# EasyEDA Pro project ca_car.eprj, board ca_pcb (continued)
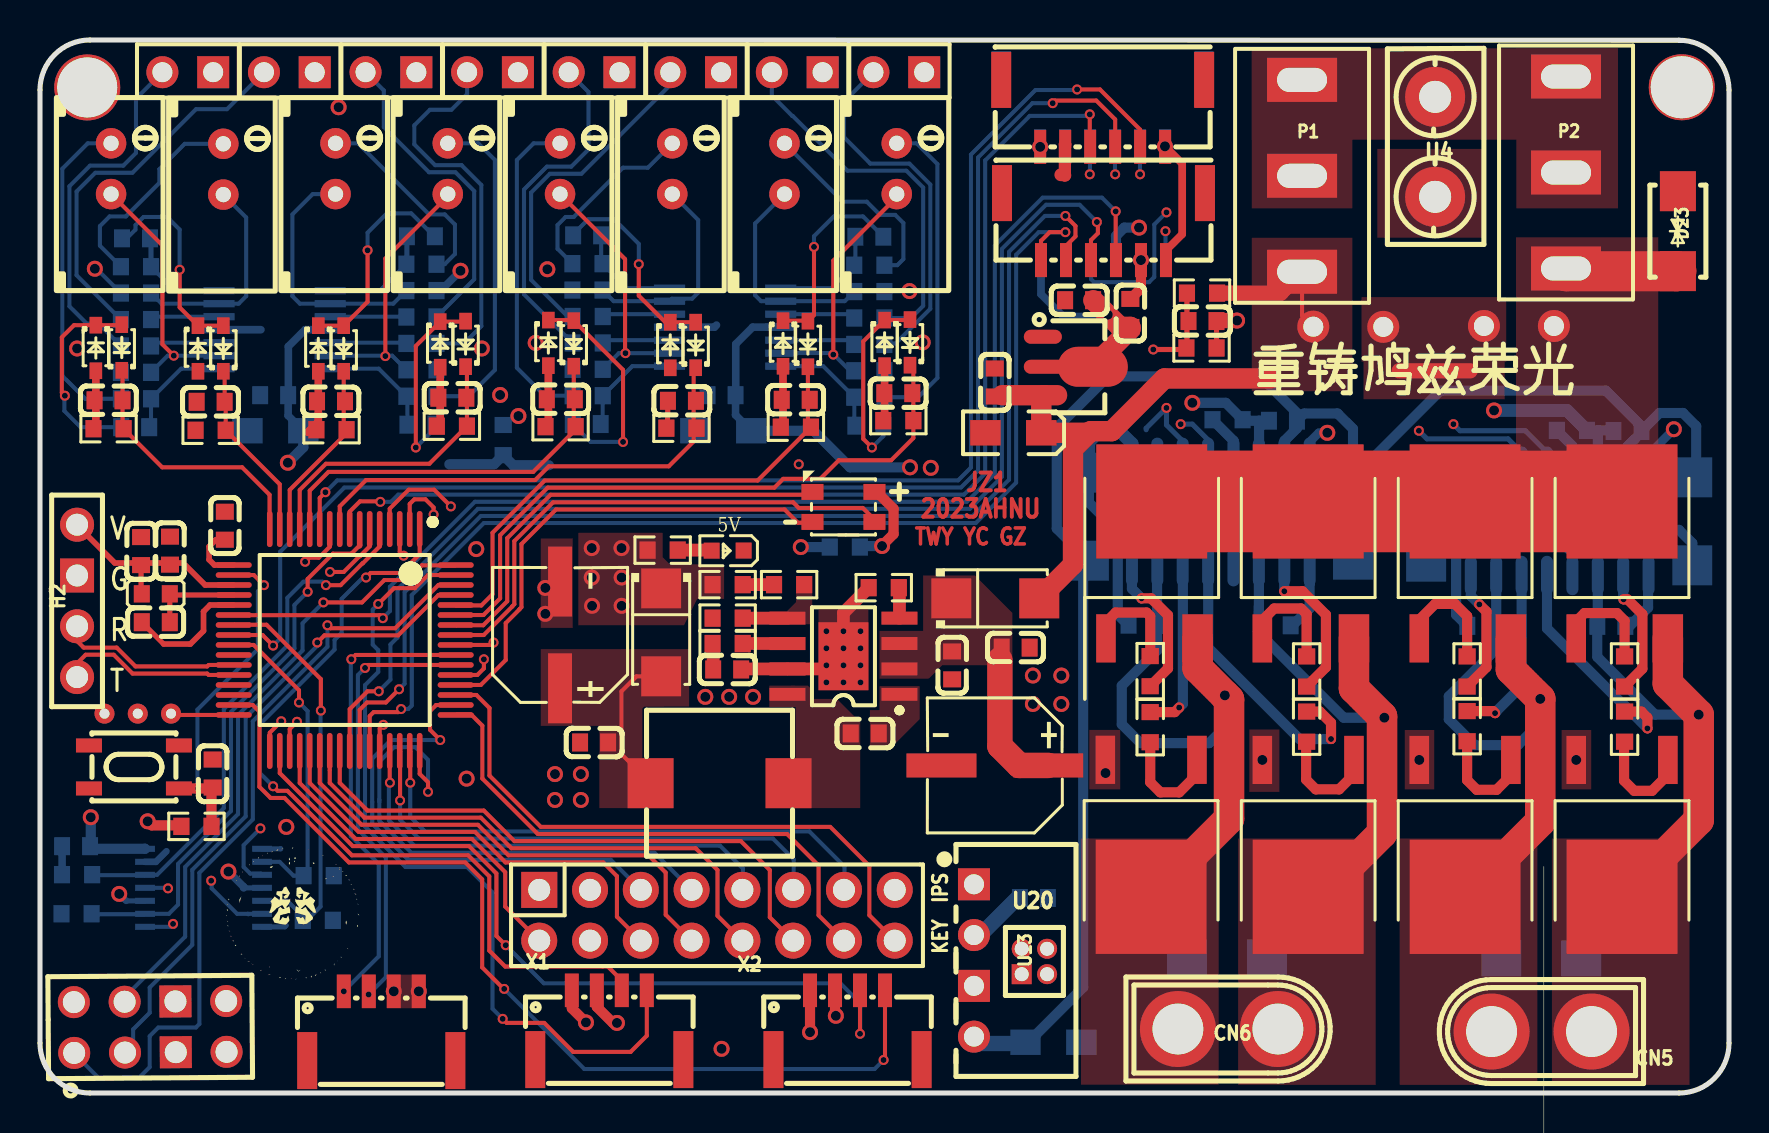
[diagram p0: board, top side]
## Routing (per net, layer and track width the routed paths; a pad name or vN(x,y) marks a point on that pad's centre or on a via; arc(x,y) is an arc through that point)
+5V: length 59.2
  Top Layer w0.254: 5.05,26.4 5.05,25.01 5.09,24.97
  Top Layer w0.28: 1.5,28.75 3.74,26.51 7.16,26.51 8.26,25.41 U10.19
  Top Layer w0.381: v2(56.26,47.35) 57.12,46.48 57.12,42.95 56.31,42.14 CN2.6
  Top Layer w0.508: X2.1 v2(38.51,3.04) 38.53,3.02 ; v2(5.39,13.59) 5.59,13.39 6.93,13.39 6.98,13.34 R57.1 ; X1.1 26.6,4.24 v2(27.31,3.53)
  Bottom Layer w0.381: C19.1 34.79,33.91 C18.2 34.8,34.91 34.8,37.46 35.64,38.3 U8.4 ; C10.1 12.41,33.88 C9.2 12.42,34.91 12.42,37.34 13.26,38.18 U5.4
  Bottom Layer w0.508: U11.14 5.25,12.22 2.63,12.22 C30.1 2.54,12.38 v2(2.54,13.79) ; v2(12.4,31.52) 13.17,32.3 C10.1 ; v2(54.97,43.28) 54.23,43.28 53.81,42.87 CN3.3 ; C19.1 38.68,33.12 40.51,31.29 v2(43.51,31.29) ; v2(38.05,27.31) R20.2
  Bottom Layer w0.762: 48.84,9.71 47.03,7.9 U13.2
  vias: v2(17.69,5.09) v2(18.94,5.09) v2(27.59,27.25) v2(27.59,25.78) v2(27.61,24.37) v2(29.08,27.25) v2(29.09,25.78) v2(29.09,24.37) v2(50.02,47.32)
+5VS: length 10.8
  Top Layer w1.016: 52.68,39.65 v2(53.4,38.93) 54.01,38.31 C48.1 54.53,38.2 U19.2
  Bottom Layer w0.381: CN3.6 50.06,39.96 51.18,38.84 53.49,38.84
+12V: length 113.7
  Bottom Layer w0.508: 76.64,27.02 79.18,29.56 U12.7 79.18,32.12 79.81,32.76 ; 76.64,27.02 U12.12 ; 76.64,27.02 74.4,29.25 73.41,29.25 72.83,29.84 U12.2 ; 62.94,33.7 62.94,33.94 61.04,35.84 53.42,35.84 50.85,33.27 50.85,28.23 D22.2 52.17,26.34 52.17,5.28 49.37,2.48 ; 62.94,33.7 C39.1 62.86,33.25 62.24,32.62 62.24,30.73 59.7,28.19 ; 62.94,33.7 63.22,33.99 64.9,33.99 65.67,33.22 65.67,31.17 ; 59.7,28.19 59.18,28.7 57.28,28.7 55.89,30.09 55.89,31.79 ; 59.7,28.19 59.7,26.32 ; 65.67,31.17 65.67,30.23 D19.2 ; 65.67,31.17 66.08,31.17 70.04,35.13 78.31,35.13 80.1,33.34 C33.1 80.99,34.01 82.17,34.01 82.83,33.35 82.83,30.99 D21.2
  Bottom Layer w0.762: U13.4 47.05,2.48 49.25,2.48
AGND: length 27.5
  Top Layer w0.254: C15.1 31.38,33.25
  Top Layer w0.381: R23.1 37.16,33.41 D13.2 ; R42.1 42.24,33.7 D15.2 ; D16.2 25.43,33.47 R43.1 ; D6.2 2.79,33.34 R19.1 ; R18.1 20.02,33.52 D5.2 ; 13.39,33.05 13.92,33.58 D3.2
  Bottom Layer w0.203: v2(2.74,41.22) 2.83,41.22 4.05,40.01
  Bottom Layer w0.381: 33.83,38.41 33.73,38.3 U8.11 ; R5.2 20.04,40.13 v2(21.03,41.12) ; U5.11 11.05,38.18
  vias: v2(1.85,37.24) v2(14.94,49.3) v2(22.1,37.24) v2(23.01,34.91) v2(23.93,33.86) v2(24.79,37.52) v2(25.37,41.2) v2(43.49,40.11) v2(44.15,37.54)
GND: length 61.5
  Top Layer w0.254: 5.09,23.55 6.18,22.45 ; C5.2 58.84,37.26 R11.2
  Top Layer w0.28: U10.21 8.51,24.41 8.18,24.08 8.18,23.11 7.52,22.45 6.18,22.45
  Top Layer w0.508: 39.8,5.1 X2.2 39.76,3.9 v2(39.8,3.86) ; v2(55.06,41.66) 55.06,40.24 C48.2 ; v2(28.85,3.51) 28.65,3.51 27.85,4.31 X1.2
  Top Layer w0.61: 51.26,45.9 51.26,47.45 51.27,47.44 CN1.2
  Top Layer w0.635: 51.05,45.92 51.23,45.92 51.26,45.9 ; R28.1 40.18,24.01 v1(40.18,23.1) v1(40.18,22.24) U7.0 39.55,21.21 U7.7 35.17,21.21 35.07,21.11
  Top Layer w0.762: 71.53,36.12 67.98,36.12 ; v2(59.87,38.63) 58.87,38.63 C5.2
  Bottom Layer w0.254: 12.04,12.22 12.03,12.21 U11.1 ; 12.32,8.38 12.25,8.31 U11.7 ; U11.10 4.31,9.61 ; U11.4 10.19,10.26
  Bottom Layer w0.33: 6.32,12.09 5.8,11.56 U11.13 ; v2(3.96,9.96) 4.31,9.61
  Bottom Layer w0.381: 10.19,10.26 10.19,10.31 v2(9.42,11.07) ; 1.1,12.34 1.1,10.92
  Bottom Layer w0.432: v2(64.38,33.02) 63.96,33.02 63.51,32.57 63.51,31.79 ; U12.8 80.45,31.94 v2(81.71,33.2)
  Bottom Layer w0.508: 60.96,33.62 61.55,33.62 ; 60.96,33.62 60.28,33.62 ; 60.96,33.62 60.97,33.62 60.97,31.79 ; v2(57.63,34.52) 59.3,34.52 R58.2 ; 20.47,31.45 22.71,31.45 R38.1 23.67,31.39 25.45,31.39 ; 77.95,33.14 77.91,33.1 U12.6 ; 77.95,33.14 R52.2 ; 77.95,33.14 78.67,33.14 C33.2
  Bottom Layer w0.635: v2(72.72,34.14) 76.37,34.14 R52.2
  vias: v1(37.95,31.45) v1(39.33,23.1) v1(39.33,22.24) v1(39.33,21.39) v1(39.33,20.54) v1(40.18,21.39) v1(40.18,20.54) v1(41.04,23.1) v1(41.04,22.24) v1(41.04,21.39) v1(41.04,20.54) v2(12.32,13.31) v2(21.34,15.72) v2(21.82,27.2) v2(25.27,25.26) v2(25.27,23.97) v2(25.76,15.95) v2(25.76,14.66) v2(27.05,15.95) v2(27.05,14.66) v2(33.27,19.81) v2(34.09,2.21) v2(34.47,19.81) v2(35.66,19.81) v2(44.55,31.27) v2(49.66,20.88) v2(49.66,19.46) v2(51.08,20.88) v2(51.08,19.46) v2(53.29,16) v2(61.13,16.66) v2(68.98,16.66) v2(76.83,16.66)
VCC: length 34.3
  Top Layer w0.203: P1.3 63.12,38.89 C45.1
  Top Layer w0.762: R10.1 62.05,40.01 P1.3
  Top Layer w1.016: 61.54,35.74 56.24,35.74 53.6,33.1 52.55,33.1 52.47,33.02 ; 52.47,33.02 51.66,32.21 51.66,26.43 D10.2 ; 52.47,33.02 C47.1 50.08,34.76 50.22,34.9 ; 48.12,34.9 50.22,34.9 ; 50.22,34.9 50.87,34.9
VCCMOTOR: length 29
  Top Layer w2: 76.33,41.1 76.34,41.1 81.83,41.1 81.84,41.11
  Top Layer w5.08: Q2.2 Q1.2 Q6.2 Q5.2
ADC_DIS1: length 80.5
  Top Layer w0.203: 18.49,28.21 18.49,29.46 18.72,29.69 19.28,29.69 19.69,29.29 v1(19.69,28.93)
  信号 w0.203: U20.3 49.1,2.74 48.03,1.68 44.68,1.68 40.46,5.89 24.08,5.89 22.02,7.95 6.45,7.95 5.77,8.63 5.77,11.87 10.44,16.55 10.44,18.57 12.52,20.65 13.31,20.65 15.37,22.71 15.37,26.4 17.52,28.55 19.3,28.55 v1(19.69,28.93)
ADC_DIS2: length 85.8
  Top Layer w0.203: U10.4 17.49,29.23 18.44,30.18 19.71,30.18 v1(20.55,29.34)
  信号 w0.203: U20.4 50.29,5.87 50.29,4.55 49.45,3.71 49.45,2.6 48.18,1.32 44.53,1.32 40.31,5.54 23.93,5.54 21.87,7.6 6.3,7.6 5.41,8.49 5.41,12.02 10.08,16.69 10.08,19.2 11.89,21.01 13.17,21.01 15.02,22.86 15.02,26.55 18.06,29.59 20.29,29.59 v1(20.55,29.34)
ADC_P00: length 32.1
  Top Layer w0.203: D17.1 43.68,36.23 R42.2 43.68,32.76 42.57,31.65 39.95,31.65 39.02,30.72 37.17,30.72 36.73,30.28 25.39,30.28 23.01,27.9 23.01,24.74 22.18,23.91 U10.59
ADC_P01: length 26.4
  Top Layer w0.203: D11.1 38.41,33.45 R23.2 35.89,30.63 25.24,30.63 22.63,28.02 22.63,24.94 22.07,24.38 20.81,24.38 U10.60
ADC_P10: length 23.9
  Top Layer w0.203: D12.1 32.69,36.17 32.69,32.59 31.45,31.34 25.45,31.34 24.77,30.66 16.31,30.66 14.99,29.34 U10.9
ADC_P13: length 13.3
  Top Layer w0.203: D8.1 4.13,36.11 C12.2 4.13,33.28 R19.2 6.11,31.29 10.11,31.29 11.48,29.92 11.48,28.22 U10.16
ADC_P14: length 19.7
  Top Layer w0.203: U10.12 13.49,30.13 14.43,31.06 24.67,31.06 26.7,33.09 26.7,33.23 ; R43.2 26.7,33.23 ; 26.7,33.23 D18.1
ADC_P15: length 14.6
  Top Layer w0.203: U10.13 12.99,30.16 14.3,31.47 19.47,31.47 R18.2 21.35,36.26 D7.1
ADC_P16: length 9.1
  Top Layer w0.203: D1.1 15.19,33.32 R1.2 15.33,33.01 12.49,30.16 U10.14
ADC_P17: length 9.1
  Top Layer w0.203: U10.15 11.99,30.44 R2.2 9.29,34.52 C2.2 9.23,36.03 D2.1
ADCBAT: length 67
  Top Layer w0.203: U10.3 17.99,27.07 v1(18.19,26.87)
  Top Layer w0.254: 57.36,37.32 57.23,37.19 v1(55.68,37.19) ; 57.36,37.32 R10.2 ; 57.36,37.32 57.36,37.29 R11.1
  信号 w0.203: v1(18.19,26.87) 20.42,26.87 23.06,29.52 47.01,29.52 49.91,32.42 49.91,43.54 50.97,44.6 57.03,44.6 57.48,44.15 57.48,38.99 v1(55.68,37.19)
ADCIN1: length 16.1
  Bottom Layer w0.203: R6.2 21.72,40.7 21.72,45.11 20.78,46.05 19.46,46.05 17.2,48.31 17.2,50.14 H3.5
ADCIN2: length 19.2
  Bottom Layer w0.203: 4.05,38.68 1.83,40.9 1.83,45.09 2.77,46.03 4.62,46.03 7.8,49.21 9.35,49.21 H3.3
ADCIN3: length 19.2
  Bottom Layer w0.203: R13.2 21.21,37.49 22.07,38.35 22.07,45.42 21.08,46.41 19.76,46.41 18.72,47.45 18.72,48.4 19.5,49.17 20.57,49.17 21.36,49.96 H3.7
ADCIN4: length 18
  Bottom Layer w0.203: H3.1 4.8,49.73 4.8,47.02 4.17,46.38 2.5,46.38 1.47,45.35 1.47,39.34 2.34,38.48 2.93,38.48 4.05,37.36
ADCIN5: length 18.8
  Bottom Layer w0.203: R32.2 43.56,38.76 44.17,39.37 44.17,45.29 43.33,46.13 40.39,46.13 37.64,48.87 37.62,48.87 36.6,49.89 H3.13
ADCIN6: length 17
  Bottom Layer w0.203: H3.11 31.52,50.42 27.08,45.97 25.5,45.97 24.56,45.03 24.56,40.67 26.39,38.84 R33.2
ADCIN7: length 18.4
  Bottom Layer w0.203: H3.15 40.21,49.59 40.21,47.8 41.53,46.48 43.48,46.48 44.53,45.44 44.53,39.22 42.79,37.49 42.28,37.49 R36.2
ADCIN8: length 17
  Bottom Layer w0.203: H3.9 27.43,50.06 27.43,47.19 26.57,46.33 25.35,46.33 24.21,45.19 24.21,39.95 R37.2
CNT_P04: length 40.9
  Top Layer w0.203: U10.63 19.4,25.91 18.75,25.25 17.7,25.25 v1(16.92,24.46) ; X1.4 30.35,2.87 29.54,2.06 26.67,2.06 25.22,3.51 23.34,3.51 v1(23.14,3.71)
  Bottom Layer w0.203: v1(23.14,3.71) 22.63,4.22 22.63,10.03 21.36,11.3 18.28,11.3 16.26,13.33 16.26,20.4 16.92,21.06 16.92,22.15 16.64,22.42 16.64,24.19 v1(16.92,24.46)
CNT_P34: length 48.6
  Top Layer w0.203: 42.19,5.06 X2.4 42.26,1.72 v1(42.19,1.65) ; 23.22,5.18 22.11,6.28 22.11,10.69 21.27,11.53 15.45,11.53 12.23,14.76 11.53,14.76 10.97,15.31 10.97,19.08 10.64,19.41 9.69,19.41
  Bottom Layer w0.203: v1(23.22,5.21) 27.22,1.2 41.74,1.2 v1(42.19,1.65)
CS: length 58.8
  Top Layer w0.203: CN2.1 50.06,42.62 50.5,43.05 v1(51.28,43.05) ; v1(18.06,19.2) 17.91,19.05 16.69,19.05 16.49,18.85 16.49,17.11
  Bottom Layer w0.203: v1(18.06,19.2) 18.42,19.2 18.59,19.38 18.59,24.9 22.2,28.51 46.8,28.51 48.82,30.53 48.82,41.92 49.95,43.05 v1(51.28,43.05)
CS_P22: length 27.2
  Top Layer w0.203: 18.49,17.11 18.52,17.08 v1(18.52,15.52)
  Bottom Layer w0.203: v1(18.52,15.52) 18.52,13.82 19.25,13.08 38.48,13.08 40.23,11.33 40.23,10.13
DC_P21: length 25.5
  Top Layer w0.203: U10.46 18.01,17.09 v1(18.01,14.63)
  Bottom Layer w0.203: 37.69,10.13 37.69,11.68 36.65,12.73 18.95,12.73 18.01,13.67 v1(18.01,14.63)
DIR_P35: length 40.5
  Top Layer w0.203: U10.34 11.99,16 15.64,12.35 21.46,12.35 22.83,10.98 22.83,7.86 v1(23.29,7.39) ; 41,2.95 v1(41.01,2.96) X2.3
  Bottom Layer w0.203: v1(41.01,2.96) 41.02,2.97 41.02,4.5 40.03,5.49 25.2,5.49 v1(23.29,7.39)
DIR_P53: length 41.6
  Top Layer w0.203: v1(11.66,15.34) 11.89,15.11 12.38,15.11 15.6,11.89 21.42,11.89 22.47,10.83 22.47,7.12 23.27,6.32 28.14,6.32 28.15,6.33 28.39,6.33 29.1,5.63 X1.3 ; v1(16.31,25.78) 16.54,26.01 18.05,26.01 18.99,26.95 U10.1
  Bottom Layer w0.203: v1(11.66,15.34) 11,16 11,18.44 14.73,22.18 14.73,22.66 15.09,23.01 15.09,24.71 16.15,25.78 v1(16.31,25.78)
K1: length 22.7
  Top Layer w0.203: 30.07,7.59 28.85,8.81 28.85,10.85 28.17,11.53 23.28,11.53 21.75,13.06 15.94,13.06 13.49,15.51 U10.37
K2: length 24.7
  Top Layer w0.203: U10.38 13.99,15.51 16.08,13.42 21.9,13.42 23.43,11.89 30.43,11.89 31.29,11.02 31.29,8.92 32.61,7.59
K3: length 26.9
  Top Layer w0.203: U10.39 14.49,15.51 16.23,13.77 22.05,13.77 23.58,12.24 32.79,12.24 33.88,11.15 33.88,8.86 35.15,7.59
K4: length 29
  Top Layer w0.203: U10.40 14.99,15.51 16.38,14.13 22.2,14.13 23.72,12.6 35.05,12.6 36.5,11.15 36.5,8.79 37.69,7.59
K5: length 17.9
  Top Layer w0.203: 24.99,7.59 23.27,9.32 23.27,11.04 21.61,12.7 15.79,12.7 12.99,15.5 U10.36
LED1: length 22
  Top Layer w0.203: 38.26,29.92 25.54,29.92 23.37,27.75 23.37,24.59 22.17,23.39 20.8,23.39 U10.58
LED2: length 25.7
  Top Layer w0.203: 20.79,22.91 22.19,22.91 23.62,24.33 23.62,24.34 23.72,24.45 23.72,27.6 25.66,29.54 37.67,29.54 37.95,29.26 41.15,29.26 41.62,28.79
LED3: length 25
  Top Layer w0.203: U10.52 22.05,20.41 23.29,21.65 23.29,23.5 23.98,24.19 23.98,24.2 24.08,24.3 24.08,27.46 25.81,29.18 37.24,29.18 37.9,28.52 38.9,28.52
MISO: length 59.6
  Top Layer w0.203: U10.42 15.99,19.16 16.36,19.53 17.3,19.53 v1(17.96,20.19) ; CN2.2 51.31,42.37 51.79,42.84 51.79,43.36 v1(51.28,43.87)
  Bottom Layer w0.203: v1(17.96,20.19) 18.24,20.47 18.24,25.05 22.05,28.86 46.65,28.86 48.46,30.67 48.46,42.07 50.26,43.87 v1(51.28,43.87)
MOSI: length 61.4
  Top Layer w0.203: U10.41 15.49,19.2 16.38,20.09 v1(16.94,20.09) ; CN2.3 52.56,42.66 52.91,43 52.91,43.51 v1(52.86,43.56)
  Bottom Layer w0.203: v1(52.86,43.56) 51.99,44.42 50.32,44.42 48.11,42.22 48.11,30.82 46.5,29.22 21.9,29.22 17.88,25.2 17.88,22.78 17.53,22.43 17.53,20.68 v1(16.94,20.09)
MOTOR1+: length 31.4
  Top Layer w0.508: 73.19,3.01 72.16,1.98
  Top Layer w1.524: Q3.2 75.03,13.57 v2(75.03,19.71) 73.56,21.18 73.56,22.74
  Bottom Layer w0.508: 72.82,23.97 72.82,22.2 70.46,19.84 70.46,18.69 71.75,17.4 73.91,17.4 75.03,18.52 v2(75.03,19.71) ; 72.83,24.01 U12.15
MOTOR1-: length 25.5
  Top Layer w1.524: 81.41,22.74 81.41,20.47 v2(82.96,18.92) 82.96,13.65 Q4.2
  Bottom Layer w0.508: v2(82.96,18.92) 80.77,18.92 77.88,21.81 77.88,24 77.91,24.02 U12.11
MOTOR2+: length 31.4
  Top Layer w1.524: Q7.2 59.47,13.71 59.47,19.68 v2(59.26,19.89) 57.89,21.25 57.89,22.74
  Bottom Layer w0.508: v2(59.26,19.89) 59.39,19.76 59.39,18.42 58.47,17.5 55.04,17.5 54.1,18.44 54.1,20.37 55.87,22.13 55.87,26.29 55.89,26.32
MOTOR2-: length 27.5
  Top Layer w1.524: 63.94,9.81 67.12,12.99 67.12,18.84 65.72,20.24 65.72,22.74
  Bottom Layer w0.508: U14.11 60.96,24.33 ; 60.96,24.33 60.91,23.06 ; 60.96,24.33 60.96,23.11 60.91,23.06 ; v2(67.23,18.77) 65.2,18.77 60.91,23.06
P11: length 16.1
  Top Layer w0.203: U10.10 14.49,27.32 13.94,26.77 13.46,26.77 v1(13.26,26.57)
  信号 w0.203: NOREF#5.3 3.23,19.76 10.04,26.57 v1(13.26,26.57)
P36: length 65.9
  Top Layer w0.203: v1(12.85,18.57) 12.49,18.2 U10.35
  信号 w0.203: v1(53.77,45.95) 53.13,45.31 50.68,45.31 49.2,43.83 49.2,32.72 46.71,30.23 22.77,30.23 20.36,27.81 17.81,27.81 17.5,27.5 ; 17.46,27.46 17.02,27.03 17.02,25.53 16.31,24.82 16.31,23.19 17.04,22.45 17.04,21.13 14.33,18.42 13.01,18.42 v1(12.85,18.57)
  Bottom Layer w0.203: 53.76,47.35 53.76,45.96 v1(53.77,45.95)
P44: length 64.9
  Top Layer w0.203: U10.44 16.99,18.23 v1(17.17,18.42)
  信号 w0.203: v1(55.02,45.95) 54.02,44.95 50.83,44.95 49.56,43.68 49.56,32.57 46.86,29.87 22.92,29.87 20.5,27.46 17.96,27.46 17.5,27 17.5,25.78 18.67,24.61 18.67,19 18.09,18.42 v1(17.17,18.42)
  Bottom Layer w0.203: 55.02,47.34 CN4.2 55.01,45.95 v1(55.02,45.95)
P50: length 3.2
  Top Layer w0.203: NOREF#2.1 6.62,18.91 U10.32
P51: length 64
  Top Layer w0.203: U10.33 11.49,18.02 v1(12.07,18.59)
  信号 w0.203: v1(52.5,45.95) 52.22,45.67 50.53,45.67 48.84,43.98 48.84,32.86 46.56,30.58 22.62,30.58 20.23,28.19 17.67,28.19 15.73,26.25 15.73,22.56 13.46,20.29 13,20.29 12.07,19.36 v1(12.07,18.59)
  Bottom Layer w0.203: CN4.4 52.51,45.96 v1(52.5,45.95)
P61: length 17.1
  Top Layer w0.203: 16,26.85 15.98,26.85 ; 16,26.85 15.98,26.85 ; 16,26.85 16.49,27.34 16.49,28.21 ; 15.98,26.85 15.19,26.06 v1(14.5,26.06)
  信号 w0.203: v1(14.5,26.06) 10.03,26.06 4.89,20.92 NOREF#3.2
PWM1: length 23.2
  Top Layer w0.203: U10.55 15.79,21.91 v1(15.57,21.69)
  Bottom Layer w0.203: v1(15.19,5.09) 16.94,6.83 16.94,11.46 15.55,12.85 15.55,21.67 v1(15.57,21.69)
PWM2: length 22
  Top Layer w0.203: v1(16.26,21.26) 16.4,21.41 U10.54
  Bottom Layer w0.203: v1(16.43,4.93) 17.3,5.79 17.3,11.78 15.9,13.18 15.9,20.9 v1(16.26,21.26)
PWM3: length 60.5
  Top Layer w0.203: U10.53 21.87,20.91 22.2,21.23 v1(22.2,21.69)
  信号 w0.203: v1(56.34,44.04) 54.46,44.04 50.27,39.85 50.27,32.27 47.15,29.16 24.7,29.16 22.18,26.64 22.18,21.71 v1(22.2,21.69)
  Bottom Layer w0.203: CN3.4 52.56,40.71 52.72,40.55 55.47,40.55 55.73,40.81 55.73,43.43 v1(56.34,44.04)
PWM4: length 53.2
  Top Layer w0.203: v1(22.68,22.53) 22.56,22.41 U10.56
  信号 w0.203: v1(56.29,43.1) 56.29,41.78 55.37,40.87 51.79,40.87 50.62,39.7 50.62,32.13 47.3,28.8 24.85,28.8 22.61,26.56 22.61,22.61 v1(22.68,22.53)
  Bottom Layer w0.203: 56.29,43.1 56.29,41.68 CN3.1
PWMA_I: length 26.5
  Top Layer w0.203: U10.5 16.99,27.34 16.14,26.49 16.13,26.49 15.04,25.4 v1(14.3,25.4)
  Bottom Layer w0.203: v1(14.3,25.4) 14.13,25.57 13.18,25.57 12.37,24.77 12.37,22.38 9.2,19.2 9.2,14.25 5.86,10.91 U11.12 5.24,10.9 2.63,10.9 R47.2
PWMA_O: length 87.7
  信号 w0.203: v1(6.4,10.24) 7.68,8.96 20.52,8.96 23.53,11.96 47.31,11.96 53.01,17.66 53.01,29.93 55.3,32.22 68.06,32.22 v1(68.96,33.12)
  Bottom Layer w0.203: v1(6.4,10.24) 6.38,10.26 U11.11
  Bottom Layer w0.254: v1(68.96,33.12) 69.37,32.72 73.42,32.72 74.1,32.04 U12.3
PWMB_I: length 27.3
  Top Layer w0.203: v1(13.39,25.07) 13.39,25.71 14.65,26.98 15.57,26.98 15.97,27.37 15.99,27.34 ; 16.03,27.38 15.99,27.34 ; 15.99,27.34 U10.7
  Bottom Layer w0.203: 2.96,8.94 5.23,8.94 U11.9 6.45,8.96 6.91,9.42 6.91,11.46 9.55,14.1 9.55,19.05 12.73,22.23 12.73,24.41 v1(13.39,25.07)
PWMB_O: length 89.1
  信号 w0.203: 6.66,8.51 6.7,8.56 20.62,8.56 23.67,11.61 47.46,11.61 53.37,17.52 53.37,29.78 55.45,31.87 68.21,31.87 68.15,31.88 69.11,31.88 v1(70.69,33.45)
  Bottom Layer w0.203: v1(6.66,8.46) 6.51,8.31 U11.8
  Bottom Layer w0.254: U12.4 75.37,32.04 74.29,33.12 71.02,33.12 v1(70.69,33.45)
PWMC_I: length 16.1
  Top Layer w0.203: U10.25 10.69,22.41 12.95,20.14 v1(12.95,19.53)
  Bottom Layer w0.203: U11.2 11.98,11.56 12.67,10.87 R50.1 13.39,11.07 13.39,19.1 v1(12.95,19.53)
PWMC_O: length 73
  信号 w0.203: v1(11.02,13.23) 11.02,11.25 12.6,9.67 20.23,9.67 23.23,12.67 47.02,12.67 52.3,17.96 52.3,30.23 v1(56.34,34.26)
  Bottom Layer w0.203: v1(11.02,13.23) 10.19,12.4 10.19,11.3 10.52,10.97 11.04,10.97 U11.3
  Bottom Layer w0.254: 55.32,33.17 55.32,33.25 v1(56.34,34.26) 56.34,33.41 57.16,32.59 57.16,31.79
PWMD_0: length 72.3
  信号 w0.203: v1(57.05,33.45) 56.03,33.45 52.65,30.08 52.65,17.81 47.16,12.32 23.38,12.32 20.38,9.32 9.78,9.32 8.56,10.54 v1(8.56,10.62)
  Bottom Layer w0.203: 10.39,8.96 9.86,8.96 8.59,10.24 8.59,10.59 v1(8.56,10.62) ; 10.39,8.96 10.42,8.94 ; 10.39,8.96 U11.6
  Bottom Layer w0.254: 58.43,31.79 58.43,32.65 57.63,33.45 v1(57.05,33.45)
PWMD_I: length 20.5
  Top Layer w0.203: U10.23 9.7,23.42 11.33,23.42 14.05,20.7 v1(14.05,19.13)
  Bottom Layer w0.203: U11.5 12.37,9.61 13.34,8.64 14.03,9.32 14.03,19.11 v1(14.05,19.13)
RST_52: length 31.2
  Top Layer w0.203: v1(14.17,24.54) 16.1,24.54 17.22,25.65 18.36,25.65 19.1,26.39 20.78,26.39 U10.64
  Bottom Layer w0.203: v1(14.17,24.54) 13.13,23.5 13.13,22.13 9.91,18.91 9.91,13.96 7.26,11.31 7.26,7.82 4.64,5.2 4.64,4.72
RST_P20: length 23.3
  Top Layer w0.203: U10.45 17.49,15.53 v1(17.5,15.52)
  Bottom Layer w0.203: v1(17.5,15.52) 17.45,15.47 17.45,13.64 18.72,12.37 34.01,12.37 35.15,11.23 35.15,10.13
RX: length 9.1
  Top Layer w0.203: U10.27 8.44,21.41 8.36,21.33 4.78,21.33 3.84,22.28 2.18,22.28 1.85,22.61 H2.3
RX_P02: length 32.1
  Top Layer w0.203: U10.61 19.93,24.91 17.91,22.89 14.23,22.89 v1(13.87,22.53)
  Bottom Layer w0.203: 4.66,2.18 4.66,3.18 5.49,4.01 5.49,5.28 7.62,7.41 7.62,11.16 10.29,13.83 10.29,18.78 13.87,22.37 v1(13.87,22.53)
SCK: length 63
  Top Layer w0.203: CN2.4 53.8,41.67 v1(53.8,44.09) ; v1(17.15,23.75) 17,23.9 9.7,23.9 U10.22
  Bottom Layer w0.203: v1(53.8,44.09) 53.11,44.78 50.14,44.78 47.75,42.39 47.75,30.97 46.36,29.57 21.75,29.57 17.5,25.32 17.5,24.1 v1(17.15,23.75)
SCL_P25: length 24.9
  Top Layer w0.203: 20.79,19.41 19.81,19.41 19.51,19.1 19.51,18.16 v1(20.02,17.65)
  Bottom Layer w0.203: 30.07,10.13 28.55,11.66 18.43,11.66 16.62,13.47 16.62,14.55 16.61,16.71 17.55,17.65 v1(20.02,17.65)
SDA_P23: length 27
  Top Layer w0.203: U10.48 18.99,15.96 19.41,15.55 v1(19.41,15.06)
  Bottom Layer w0.203: 16.97,14.66 16.97,14.56 ; 16.97,14.66 16.97,13.62 18.57,12.01 30.73,12.01 32.61,10.13 ; 16.97,14.66 16.97,16.57 17.7,17.3 18.77,17.3 19.41,16.66 v1(19.41,15.06)
SW1: length 27.1
  Top Layer w0.203: U10.49 21.59,18.91 22.12,18.37 22.12,15.73 24.9,12.95 37.36,12.95 38.94,11.38 38.94,8.89 40.23,7.59
SW2: length 30.5
  Top Layer w0.203: 屏幕.2 41.48,8.89 41.48,11.35 39.52,13.31 25.05,13.31 22.48,15.88 22.48,19.25 21.83,19.91 U10.51
TOF_SCL: length 56.9
  Top Layer w0.203: v1(52.5,48.95) 52.5,47.34 CN1.3 ; v1(17.02,29.57) 16.99,29.59 16,29.59 15.49,29.08 U10.8
  Bottom Layer w0.203: v1(17.02,29.57) 17.55,29.57 17.91,29.93 46.21,29.93 47.27,30.99 47.27,46.64 49.5,48.87 52.43,48.87 v1(52.5,48.95)
TOF_SDA: length 69.1
  Top Layer w0.203: CN1.4 53.77,48.69 52.83,49.64 50.78,49.64 v1(50.65,49.5) ; 9.69,22.91 11.13,22.91 v1(11.66,22.38)
  Bottom Layer w0.203: v1(11.66,22.38) 12.01,22.73 12.01,27.08 15.22,30.28 46.06,30.28 46.91,31.14 46.91,46.79 49.63,49.5 v1(50.65,49.5)
TOF_XS: length 61.9
  Top Layer w0.203: v1(14.28,30.05) 13.99,29.76 U10.11 ; v1(51.87,50.19) 53.01,50.19 55.02,48.18 CN1.5
  Bottom Layer w0.203: v1(14.28,30.05) 14.87,30.64 45.91,30.64 46.56,31.28 46.56,46.93 49.78,50.16 51.84,50.16 v1(51.87,50.19)
TX: length 9.1
  Top Layer w0.203: U10.28 8.44,20.91 8.36,20.98 4.63,20.98 3.69,21.92 2.29,21.92 1.85,21.49 H2.4
TX_P03: length 38.7
  Top Layer w0.203: U10.62 19.93,25.41 17.76,23.25 14.53,23.25 v1(14.38,23.39)
  Bottom Layer w0.203: v1(14.38,23.39) 14.38,22.33 10.64,18.59 10.64,13.69 7.97,11.01 7.97,3.45 7.8,3.28 5.92,3.28 5.49,2.85 5.49,1.3 4.98,0.79 2.9,0.79 2.12,1.57 2.12,2.16
$1N4829: length 6.3
  Top Layer w0.508: R44.1 72.34,21.29 72.34,24.08 v1(71.98,24.44)
  Bottom Layer w0.508: v1(71.98,24.44) 71.56,24.86 U12.16
$1N6782: length 5.9
  Top Layer w0.508: R44.2 71.37,23.85 70.76,24.46 69.77,24.46 68.98,23.67 68.98,22.74
$1N6904: length 5.4
  Top Layer w0.508: R45.1 79.25,23.62 78.87,24 77.24,24 76.83,23.59 76.83,22.74
$1N6954: length 8.7
  Bottom Layer w0.508: C32.2 79.31,23.34 79.49,23.34 80.42,24.28 80.42,25.86 U12.9 80.45,27.68 80.93,28.16 81.97,28.16 82.63,27.5 D21.1
$1N7218: length 6.4
  Top Layer w0.508: v1(79.2,24.69) 79.39,24.69 80.14,23.95 80.14,21.22 R45.2
  Bottom Layer w0.508: v1(79.2,24.69) 79.18,24.71 U12.10
$1N7863: length 11.5
  Top Layer w0.508: R49.2 80.09,19.08 80.39,18.77 v1(80.39,18.24)
  Bottom Layer w0.508: v1(80.39,18.24) 79.2,19.43 79.17,19.43 75.37,23.23 U12.13
$1N7949: length 8.9
  Top Layer w0.508: v1(72.77,19) 72.67,19.1 R48.1
  Bottom Layer w0.508: U12.14 74.1,20.35 72.82,19.08 72.82,19.05 v1(72.77,19)
$1N8515: length 5.4
  Top Layer w0.508: R48.2 71.37,15.65 71.86,15.16 72.85,15.16 73.56,15.88 Q3.1
$1N8874: length 5.4
  Top Layer w0.508: R49.1 79.22,17.54 79.22,15.62 79.73,15.11 80.62,15.11 81.41,15.91 Q4.1
$1N11903: length 12.2
  Bottom Layer w0.508: D19.1 69.32,29.43 70.82,27.93 ; 71.42,23.32 70.82,23.92 70.82,27.93 ; U12.1 71.56,28.67 70.82,27.93
$1N14158: length 7.4
  Top Layer w0.508: R53.1 56.41,21.23 56.41,23.9 55.57,24.74 v1(55.09,24.74)
  Bottom Layer w0.381: v1(55.09,24.74) 55.09,24.66
  Bottom Layer w0.508: U14.16 54.61,25.22 v1(55.09,24.74)
$1N14159: length 5.3
  Top Layer w0.508: 55.52,21.85 55.52,23.85 55.35,24.03 53.8,24.03 53.31,23.54 53.31,22.74
$1N14160: length 5.6
  Top Layer w0.508: R54.1 63.35,23.95 63.07,24.23 61.72,24.23 61.13,23.64 61.13,22.74
$1N14162: length 9.7
  Bottom Layer w0.508: 63.5,25.52 63.5,24.24 62.52,23.27 ; 63.5,25.52 U14.9 ; 63.5,25.52 63.51,25.53 63.51,28.11 63.86,28.47 64.98,28.47 65.67,27.78 D25.1
$1N14163: length 8.7
  Top Layer w0.508: v1(56.97,19.28) 56.74,19.05 R55.1
  Bottom Layer w0.508: v1(56.97,19.28) 57.16,19.46 57.16,26.32
$1N14164: length 5.7
  Top Layer w0.508: Q7.1 57.86,15.93 56.97,15.04 56.03,15.04 55.52,15.55 R55.2
$1N14165: length 5.5
  Top Layer w0.508: Q8.1 65.72,15.93 64.97,15.19 63.81,15.19 63.32,15.67 63.32,17.54 R56.1
$1N14166: length 14.3
  Top Layer w0.508: R56.2 64.01,19.08 64.57,18.52 v1(64.57,17.7)
  Bottom Layer w0.508: 58.43,26.32 58.43,22.27 62.99,17.7 v1(64.57,17.7)
$1N14168: length 7.8
  Top Layer w0.508: v1(62.23,25.1) 63.14,25.1 64.31,23.92 64.31,21.29 R54.2
  Bottom Layer w0.508: v1(62.23,25.1) U14.10
$1N14171: length 13.3
  Bottom Layer w0.508: D22.1 52.46,29.53 53.9,28.09 53.9,23.93 54.41,23.42 C36.2
  Bottom Layer w0.635: D22.1 52.46,32.56 52.94,33.04 54.06,33.04 54.62,32.48 54.62,31.79
$1N161006: length 4.6
  Top Layer w0.508: 42.11,27.38 42.69,27.96 42.69,29.22 41.73,30.17
  Bottom Layer w0.508: R20.1 41.05,27.36 v2(42.11,27.36)
$1N164801: length 17.7
  Top Layer w0.203: 8.39,15.23 8.66,15.51 8.66,15.21 ; 8.66,13.42 R57.2 ; v1(11.2,25.4) 10.7,25.91 U10.18
  Top Layer w0.508: R57.2 8.58,15.13 8.66,15.21 ; K1.2 v1(7.91,15.23) 8.59,15.23 C41.1
  Bottom Layer w0.203: 7.87,15.24 7.87,19.18 10.9,22.2 10.9,25.1 v1(11.2,25.4)
$1N166533: length 2.9
  Top Layer w0.28: U10.17 8.72,26.41 8.46,26.67 8.46,27.33 8.8,27.67 C40.2
$1N172196: length 2.1
  Bottom Layer w0.508: R52.1 76.64,32.36 U12.5
$1N173888: length 2.3
  Bottom Layer w0.508: 59.7,31.79 59.7,32.62 R58.1
$1N187403: length 10.3
  Bottom Layer w0.203: R3.1 20.24,41.45 20.75,41.96 20.75,43.43 20.24,43.94 19.46,43.94 15.9,47.5 VR1.1
$1N187731: length 12.8
  Bottom Layer w0.203: R5.1 17.67,39.48 U5.2 13,39.48 12.62,39.85 12.62,43.94 13.64,44.96 VR1.2
$1N189829: length 3.8
  Bottom Layer w0.203: R6.1 18.31,38.83 U5.3
$1N201850: length 5.8
  Bottom Layer w0.203: U5.1 17,40.13 R3.2
  Bottom Layer w0.254: R3.2 18.35,41.48 C3.1
$1N279025: length 4.6
  Top Layer w0.254: U10.20 6.68,24.91 ; 6.68,24.91 6.49,24.72 C42.2 ; 6.68,24.91 6.59,24.99
$1N320512: length 10.8
  Top Layer w0.203: v1(16.38,42.15) 16.38,39.57 D1.2 D3.1
  Bottom Layer w0.203: C3.2 19.71,42.85 18.57,43.99 17.35,43.99 16.38,43.03 16.38,42.04
$1N344378: length 3.5
  Bottom Layer w0.203: R7.1 5.7,38.83 U5.12
$1N344380: length 10.7
  Bottom Layer w0.203: VR2.2 10.31,43.79 10.31,39.85 9.94,39.48 U5.13 6.08,39.48 R8.1
$1N344381: length 10.7
  Bottom Layer w0.203: 4.05,41.33 3,42.38 3,43.36 3.48,43.84 4.29,43.84 5.97,45.52 5.97,46.2 7.24,47.47 VR2.1
$1N344382: length 5.3
  Bottom Layer w0.203: R4.2 6.75,40.13 U5.14
  Bottom Layer w0.254: C4.1 5.55,42.7 R4.2
$1N344383: length 10.2
  Top Layer w0.203: v1(6.98,41.17) 6.98,39.29 D4.1 D2.2
  Bottom Layer w0.203: v1(6.98,41.17) 6.98,43.18 6.35,43.82 5.18,43.82 4.78,43.41 4.78,43.18 4.34,42.75 C4.2
$1N374790: length 3.8
  Bottom Layer w0.203: U5.5 18.29,37.53 R13.1
$1N374792: length 13.5
  Top Layer w0.203: v1(17.27,36.86) 17.27,41.73 20.4,44.86 VR3.2
  Bottom Layer w0.203: 14.52,36.88 17.62,36.88 R12.1
$1N374793: length 16.7
  Bottom Layer w0.203: VR3.1 21.92,47.5 22.75,46.67 22.75,36.16 21.44,34.85 R16.1
$1N374794: length 5.8
  Bottom Layer w0.203: U5.7 16.94,36.23 R16.2 18.38,34.8 C7.1
$1N374795: length 9.6
  Top Layer w0.203: v1(18.8,32.28) 18.8,37.36 D5.1 21.26,38.58 D7.2
  Bottom Layer w0.203: v1(18.8,32.28) 19.78,33.26 C7.2
$1N374798: length 3.5
  Bottom Layer w0.203: R14.1 5.72,37.53 U5.10
$1N374800: length 13.1
  Top Layer w0.203: v1(6.69,36.88) 6.12,37.45 6.12,42.39 VR4.2
  Bottom Layer w0.203: 8.96,36.88 v1(6.69,36.88) 6.39,36.88 R15.1
$1N374801: length 16.7
  Bottom Layer w0.203: 4.05,34.72 2.26,34.72 1.12,35.87 1.12,46.23 2.39,47.5 VR4.1
$1N374802: length 5.5
  Bottom Layer w0.203: U5.8 7.06,36.23 R17.2 5.55,33.39 C8.1
$1N374803: length 10.2
  Top Layer w0.203: D8.2 4.06,38.4 D6.1 1.7,38.4 1.09,37.8 1.09,35.03 v1(1.24,34.87)
  Bottom Layer w0.203: C8.2 2.03,33.3 1.22,34.11 1.22,34.85 v1(1.24,34.87)
$1N379031: length 3.8
  Bottom Layer w0.203: U8.3 40.53,38.95 R32.1
$1N379035: length 10.9
  Bottom Layer w0.203: R31.1 40.25,39.6 U8.2 36.06,39.6 35.76,39.9 35.76,43.49 VR5.2
$1N379036: length 10.5
  Bottom Layer w0.203: VR5.1 40.16,44.58 41.35,44.58 42.01,43.92 42.77,43.92 43.18,43.51 43.18,41.71 42.88,41.4 R26.1
$1N379037: length 5.6
  Bottom Layer w0.203: U8.1 39.58,40.25 R26.2 40.78,41.46 C20.1
$1N379038: length 9.9
  Top Layer w0.203: D13.1 38.38,38.63 D11.2 38.71,38.91 v1(38.71,42.32)
  Bottom Layer w0.203: C20.2 41.16,43.84 39.7,43.84 38.71,42.85 v1(38.71,42.32)
$1N379041: length 3.4
  Bottom Layer w0.203: U8.12 28.26,38.95 R33.1
$1N379043: length 10.7
  Bottom Layer w0.203: VR6.2 32.92,43.66 32.92,40.03 32.61,39.73 31.61,39.73 U8.13 28.69,39.6 R34.1
$1N379044: length 9.7
  Bottom Layer w0.203: VR6.1 30.4,46.28 29.16,46.28 26.7,43.82 26.29,43.82 25.88,43.41 25.88,42.22 R27.1
$1N379045: length 5.3
  Bottom Layer w0.203: C21.1 28.07,41.55 R27.2 29.36,40.25 U8.14
$1N379051: length 3.8
  Bottom Layer w0.203: R36.1 40.51,37.65 U8.5
$1N379053: length 13.5
  Top Layer w0.203: VR7.2 42.93,44.88 39.68,41.63 v1(39.68,36.93)
  Bottom Layer w0.203: R35.1 40.51,36.12 39.62,37.01 37.05,37.01 U8.6
$1N379054: length 16.2
  Bottom Layer w0.203: R40.1 43.92,34.8 44.88,35.76 44.88,46.46 43.84,47.5 VR7.1
$1N379055: length 5.8
  Bottom Layer w0.203: C26.1 40.72,33.43 R40.2 39.17,36.35 U8.7
$1N379056: length 9.6
  Top Layer w0.203: v1(41.61,32.28) 41.17,32.72 41.17,37.59 D15.1 43.49,38.66 D17.2
  Bottom Layer w0.203: v1(41.61,32.28) 42.18,32.86 C26.2
$1N379059: length 3.4
  Bottom Layer w0.203: U8.10 28.28,37.65 R37.1
$1N379061: length 13
  Top Layer w0.203: 29.26,36.98 29.26,41.71 VR8.2
  Bottom Layer w0.203: R39.1 28.95,37 v1(29.28,37) U8.9
$1N379062: length 16.3
  Bottom Layer w0.203: R41.1 25.25,34.87 23.85,36.27 23.85,46.66 24.69,47.5 VR8.1
$1N379063: length 5.4
  Bottom Layer w0.203: C27.1 28.14,33.55 R41.2 29.62,36.35 U8.8
$1N379064: length 11.3
  Top Layer w0.203: D16.1 26.67,38.66 D18.2 29.16,36.17 v1(29.16,32.56)
  Bottom Layer w0.203: 26.65,33.46 27.54,32.56 v1(29.16,32.56)
$1N379068: length 10.1
  Top Layer w0.203: D12.2 31.52,38.55 D14.1 31.27,38.55 29.95,39.88 v1(29.95,41.45)
  Bottom Layer w0.203: C21.2 26.67,42.95 27.42,43.7 28.71,43.7 29.95,42.47 v1(29.95,41.45)
$1N458057: length 7.1
  Top Layer w1.27: 48.01,21.67 48.01,17.35 48.97,16.38 C22.1
$1N471687: length 1.5
  Top Layer w0.635: U7.4 42.98,25.24 R28.2
$1N474432: length 1.3
  Top Layer w0.635: C25.2 33.67,22.45 R30.1
$1N474773: length 2.3
  Top Layer w0.635: U7.6 35.2,22.48 35.15,22.53
$1N478879: length 7.5
  Top Layer w0.203: D9.2 29.83,20.84 29.08,20.09 29.08,16.95 L1.2
$1N485591: length 1.6
  Top Layer w0.635: R25.1 R21.2
$1N487218: length 2.3
  Top Layer w0.635: U7.5 35.22,23.75 35.15,23.83
$1N494652: length 1.7
  Top Layer w0.635: LED2.2 33.56,27.15 R22.2

## Copper pours and planes (outline as drawn; the poured copper is in the pictures)
+5V on Top Layer: 17.35,5.92 19.3,5.92 19.3,4.24 17.35,4.24
+5V on Top Layer: 26.92,28.02 34.21,28.02 34.21,23.39 26.92,23.39
+5V on 电源: 45.54,52.65 45.54,32 0,32 0,0 84.47,0 84.47,52.66 45.55,52.66
AGND on Top Layer: 0,52.67 45.54,52.67 45.54,32.03 0,32.03
AGND on Bottom Layer: 0,52.65 45.54,52.65 45.54,32 0,32
AGND on 地1: 0,52.67 45.54,52.67 45.54,32.03 0,32.03
AGND on 信号: 0,52.67 45.64,52.67 45.64,32.03 0,32.03
AGND on 电源: 0,52.67 45.54,52.67 45.54,32.03 0,32.03
AGND on 地2: 0,52.67 45.54,52.67 45.54,32.03 0,32.03
GND on Top Layer: 45.54,52.65 45.54,32 0,32 0,0 84.47,0 84.47,52.66 45.55,52.66
GND on Top Layer: 68.25,18.16 69.73,18.16 69.73,15.19 68.25,15.19
GND on Top Layer: 66.09,39.8 73.33,39.8 73.33,36.58 66.09,36.58
GND on Top Layer: 60.48,18.18 61.98,18.18 61.98,15.06 60.48,15.06
GND on Top Layer: 38.94,24.18 41.43,24.18 41.43,22.86 38.94,22.86
GND on Top Layer: 66.19,37.49 73.25,37.49 73.25,34.7 66.19,34.7
GND on Top Layer: 25.04,27.74 26.64,27.74 26.64,23.27 25.04,23.27
GND on Top Layer: 76.1,18.16 77.58,18.16 77.58,15.19 76.1,15.19
GND on Top Layer: 66.88,47.22 72.29,47.22 72.29,42.77 66.88,42.77
GND on Top Layer: 52.48,18.16 54.03,18.16 54.03,15.19 52.48,15.19
GND on Bottom Layer: 45.54,52.65 45.54,32 0,32 0,0 84.47,0 84.47,52.66 45.55,52.66
GND on Bottom Layer: 65.71,40.13 73.61,40.13 73.61,36.98 65.71,36.98
GND on Bottom Layer: 66.93,47.04 72.54,47.04 72.54,42.85 66.93,42.85
GND on 地1: 67.21,46.91 72.16,46.91 72.16,42.09 67.21,42.09
GND on 地1: 45.54,52.65 45.54,32 0,32 0,0 84.47,0 84.47,52.66 45.55,52.66
